# EasyEDA Pro project Athena.epro, schematic Schematic, sheets 3 to 4 of 4

## Sheets
3 Peripherals: Page Name: Peripherals
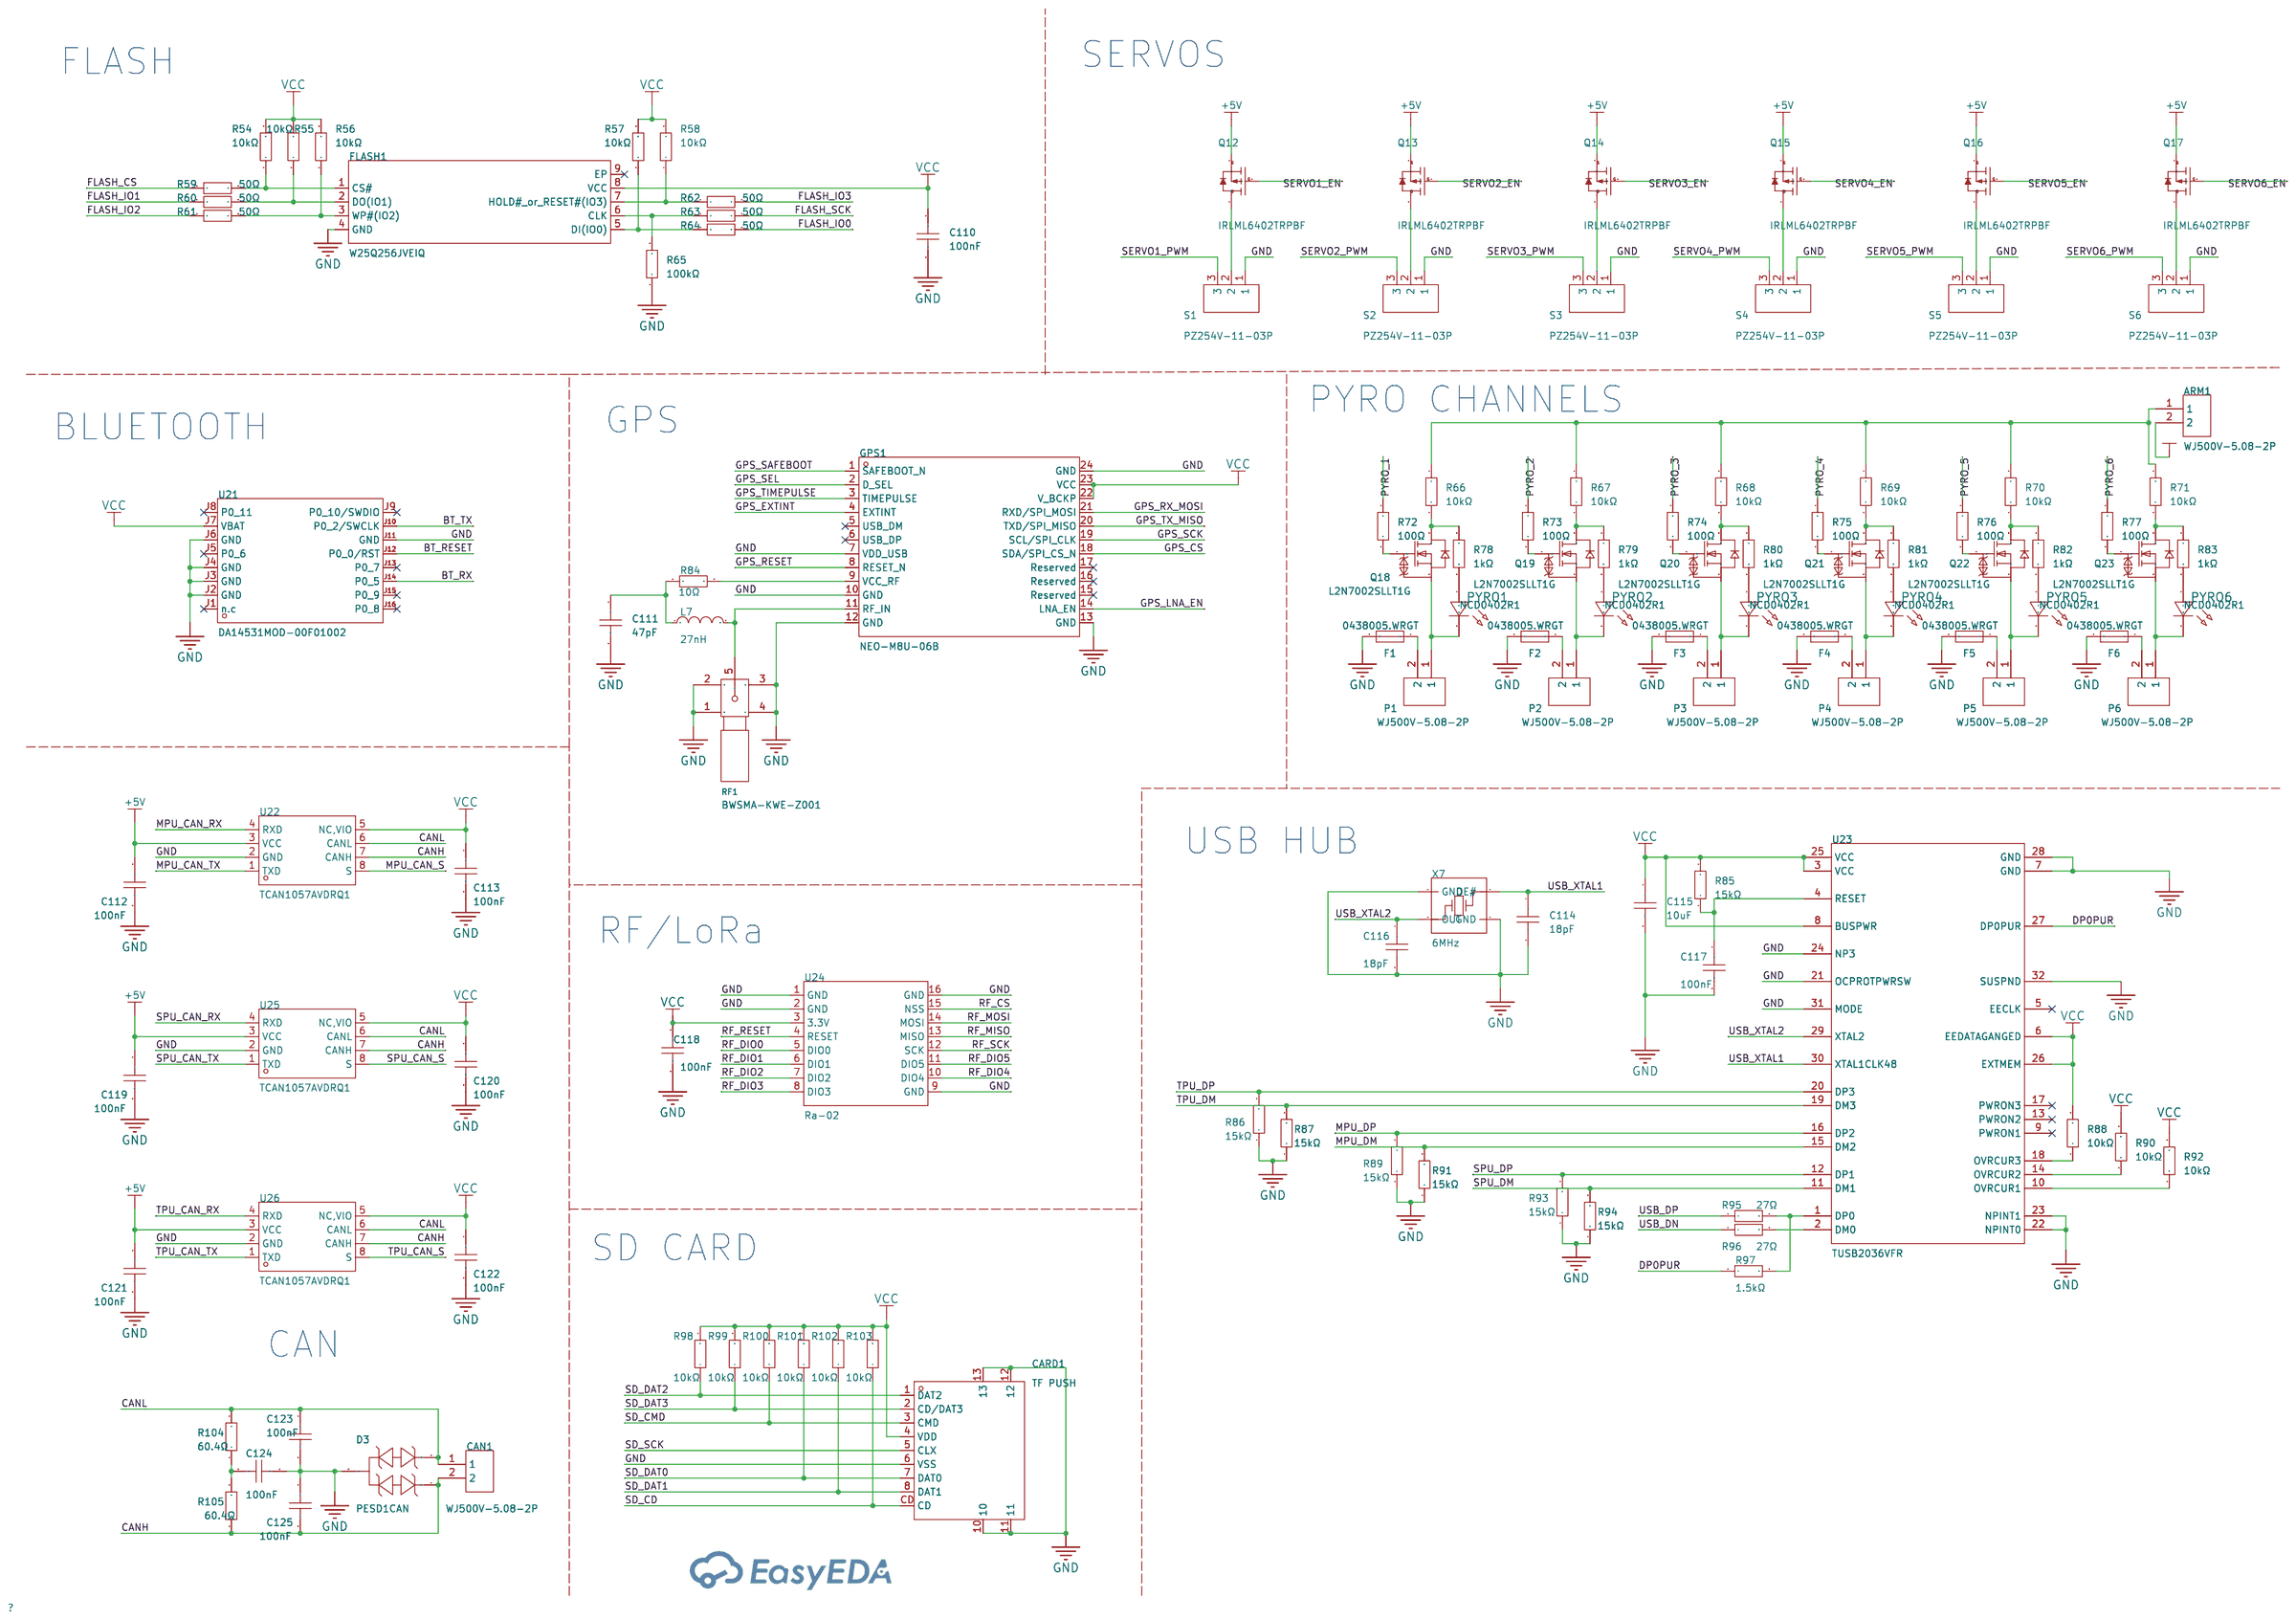
[diagram p2: Peripherals]
4 Sensors: Page Name: Sensors; Update Date: 2025-08-21
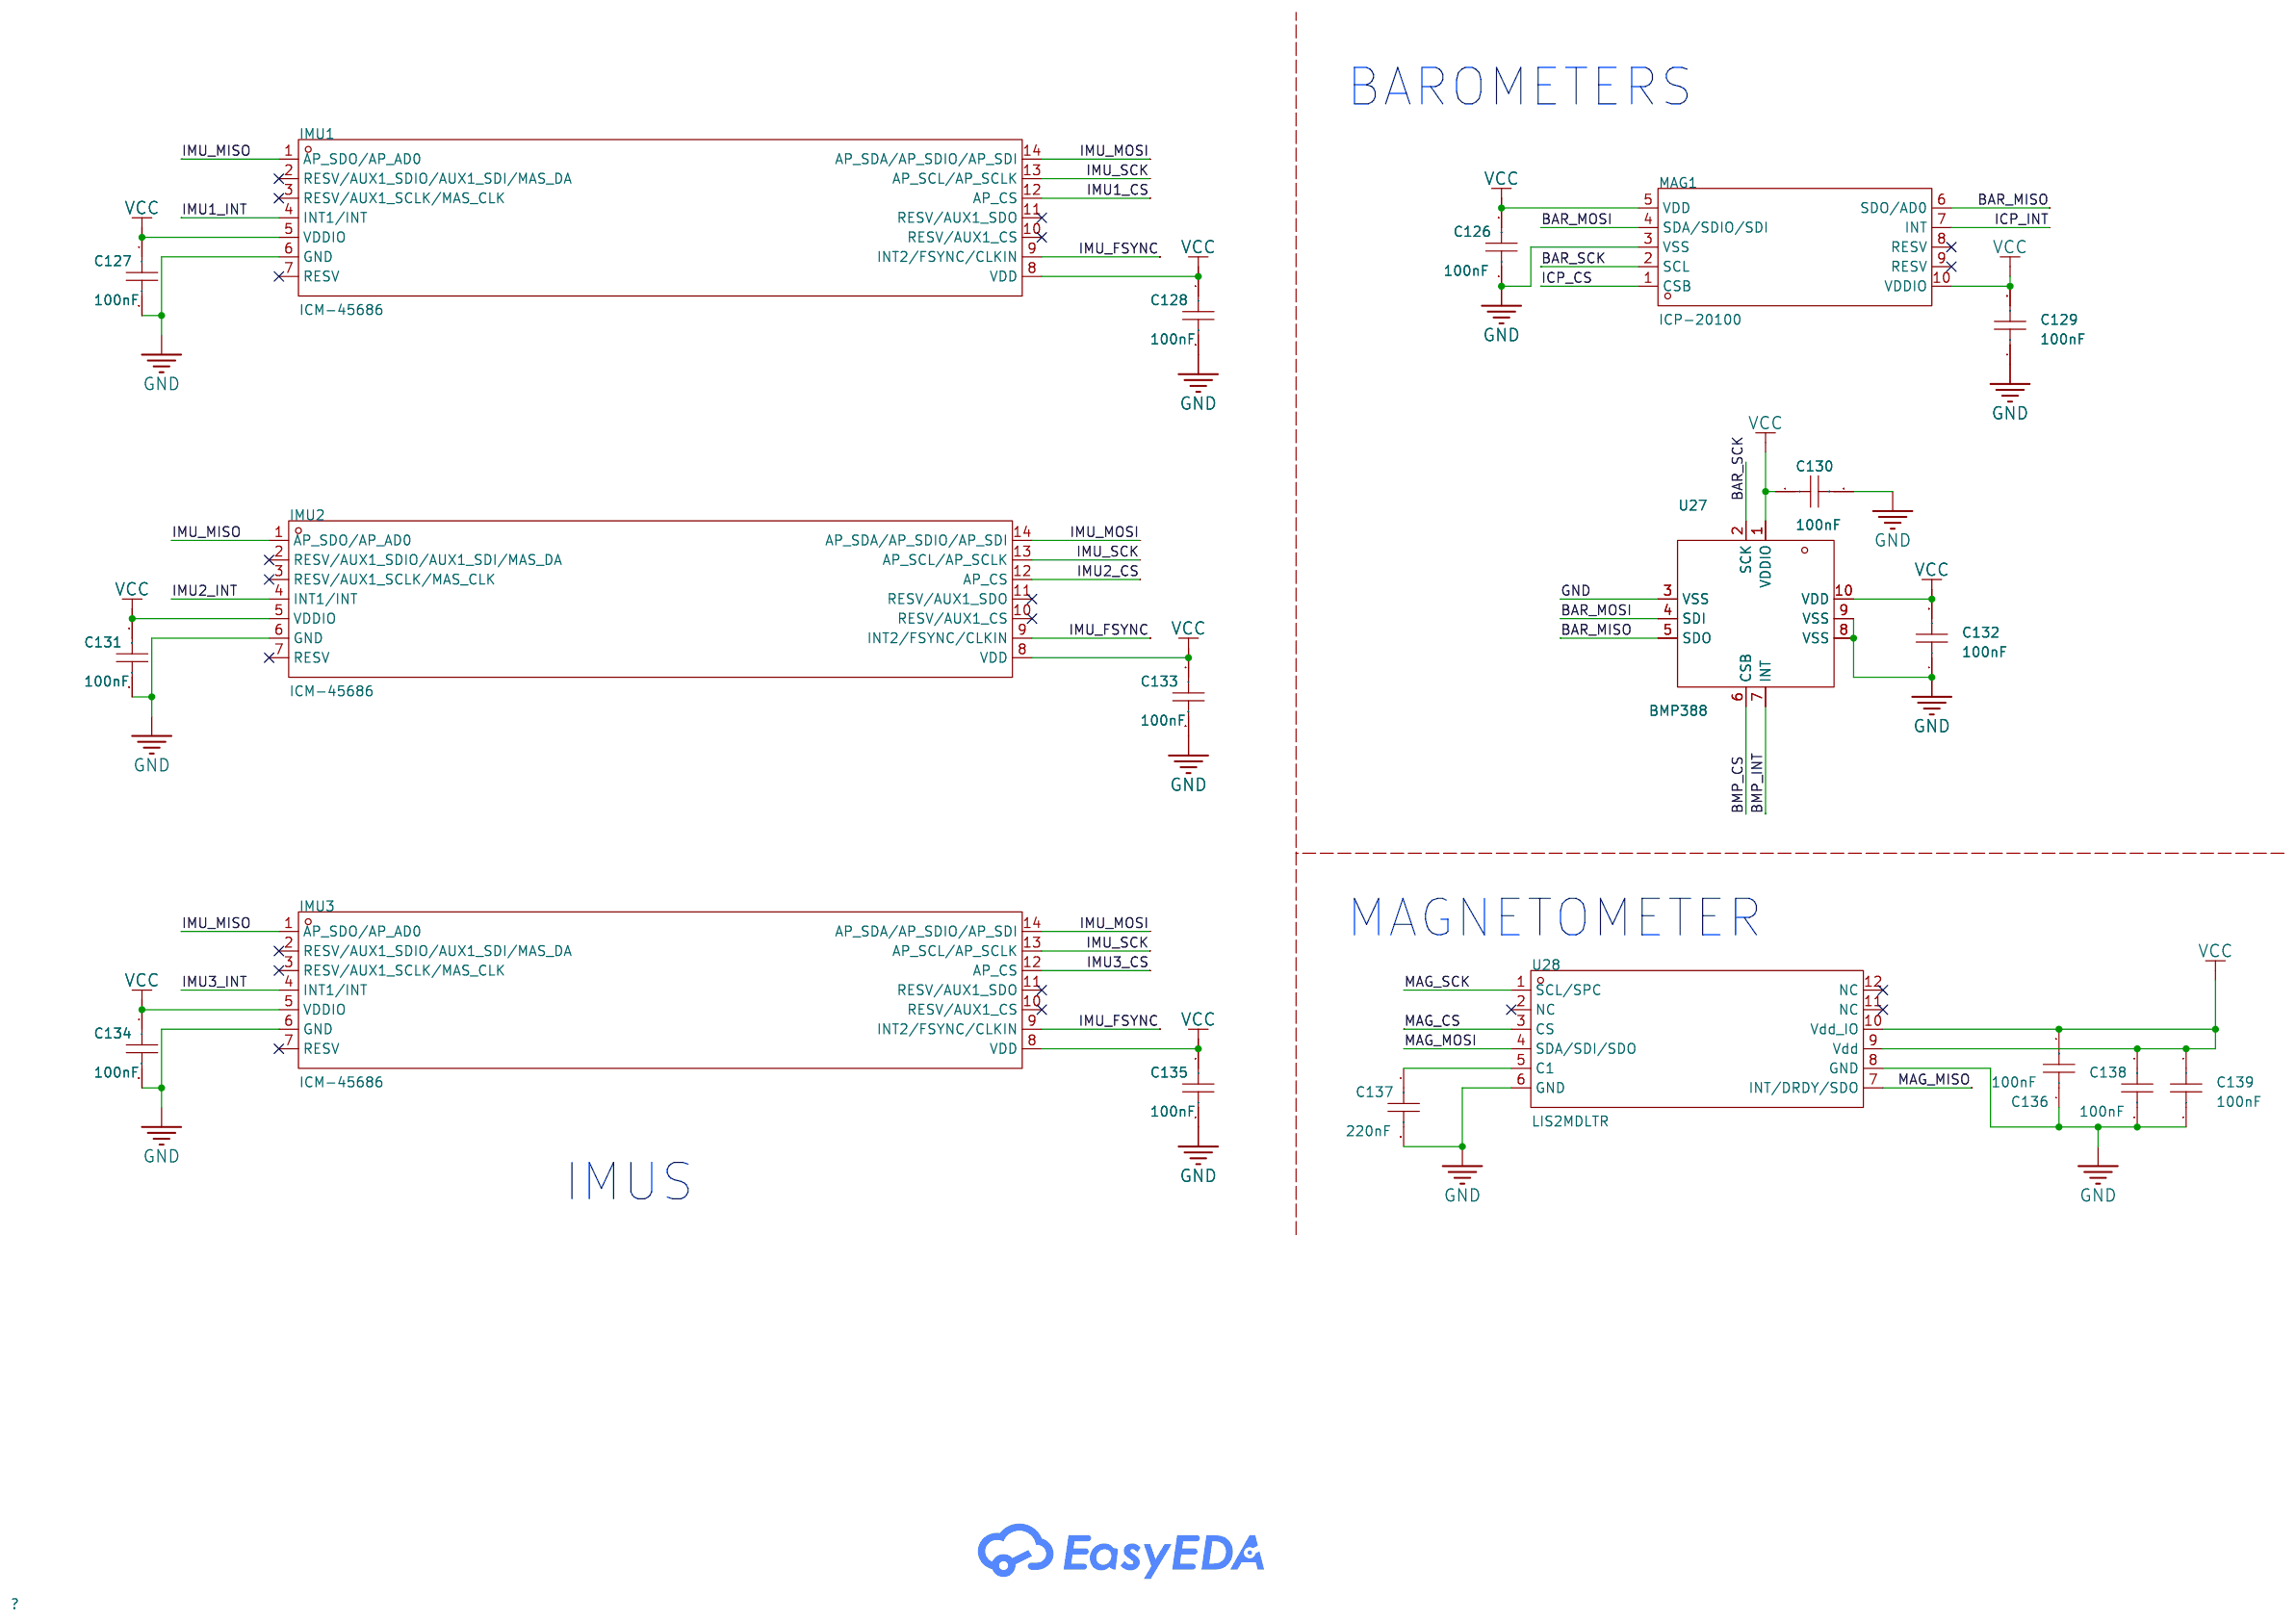
[diagram p3: Sensors]

## Parts
sheet Peripherals
ARM1  WJ500V-5.08-2P  [CONN-TH_2P-P5.00_WJ500V-5.08-2P]
C110  100nF  [C0402]
C111  47pF  [C0402]
C112  100nF  [C0402]
C113  100nF  [C0402]
C114  18pF  [C0402]
C115  10uF  [C0805]
C116  18pF  [C0402]
C117  100nF  [C0402]
C118  100nF  [C0402]
C119  100nF  [C0402]
C120  100nF  [C0402]
C121  100nF  [C0402]
C122  100nF  [C0402]
C123  100nF  [C0402]
C124  100nF  [C0402]
C125  100nF  [C0402]
CAN1  WJ500V-5.08-2P  [CONN-TH_2P-P5.00_WJ500V-5.08-2P]
CARD1  TF PUSH  [TF-SMD_TF-PUSH]
D3  PESD1CAN  [SOT-23-3_L2.9-W1.6-P1.90-LS2.8-BR]
F1  0438005.WRGT  [F0603]
F2  0438005.WRGT  [F0603]
F3  0438005.WRGT  [F0603]
F4  0438005.WRGT  [F0603]
F5  0438005.WRGT  [F0603]
F6  0438005.WRGT  [F0603]
FLASH1  W25Q256JVEIQ  [WSON-8_L8.0-W6.10-P1.27-BL-EP]
GPS1  NEO-M8U-06B  [GPSM-SMD_24P-L16.0-W12.2-P1.10-TL]
L7  27nH  [L0402-RD]
P1  WJ500V-5.08-2P  [CONN-TH_2P-P5.00_WJ500V-5.08-2P]
P2  WJ500V-5.08-2P  [CONN-TH_2P-P5.00_WJ500V-5.08-2P]
P3  WJ500V-5.08-2P  [CONN-TH_2P-P5.00_WJ500V-5.08-2P]
P4  WJ500V-5.08-2P  [CONN-TH_2P-P5.00_WJ500V-5.08-2P]
P5  WJ500V-5.08-2P  [CONN-TH_2P-P5.00_WJ500V-5.08-2P]
P6  WJ500V-5.08-2P  [CONN-TH_2P-P5.00_WJ500V-5.08-2P]
PYRO1  NCD0402R1  [LED0402-RD]
PYRO2  NCD0402R1  [LED0402-RD]
PYRO3  NCD0402R1  [LED0402-RD]
PYRO4  NCD0402R1  [LED0402-RD]
PYRO5  NCD0402R1  [LED0402-RD]
PYRO6  NCD0402R1  [LED0402-RD]
Q12  IRLML6402TRPBF  [SOT-23-3_L2.9-W1.3-P1.90-LS2.4-BR]
Q13  IRLML6402TRPBF  [SOT-23-3_L2.9-W1.3-P1.90-LS2.4-BR]
Q14  IRLML6402TRPBF  [SOT-23-3_L2.9-W1.3-P1.90-LS2.4-BR]
Q15  IRLML6402TRPBF  [SOT-23-3_L2.9-W1.3-P1.90-LS2.4-BR]
Q16  IRLML6402TRPBF  [SOT-23-3_L2.9-W1.3-P1.90-LS2.4-BR]
Q17  IRLML6402TRPBF  [SOT-23-3_L2.9-W1.3-P1.90-LS2.4-BR]
Q18  L2N7002SLLT1G  [SOT-23-3_L3.0-W1.7-P0.95-LS2.9-BR]
Q19  L2N7002SLLT1G  [SOT-23-3_L3.0-W1.7-P0.95-LS2.9-BR]
Q20  L2N7002SLLT1G  [SOT-23-3_L3.0-W1.7-P0.95-LS2.9-BR]
Q21  L2N7002SLLT1G  [SOT-23-3_L3.0-W1.7-P0.95-LS2.9-BR]
Q22  L2N7002SLLT1G  [SOT-23-3_L3.0-W1.7-P0.95-LS2.9-BR]
Q23  L2N7002SLLT1G  [SOT-23-3_L3.0-W1.7-P0.95-LS2.9-BR]
R54  10kΩ  [R0402]
R55  10kΩ  [R0402]
R56  10kΩ  [R0402]
R57  10kΩ  [R0402]
R58  10kΩ  [R0402]
R59  50Ω  [R0402]
R60  50Ω  [R0402]
R61  50Ω  [R0402]
R62  50Ω  [R0402]
R63  50Ω  [R0402]
R64  50Ω  [R0402]
R65  100kΩ  [R0402]
R66  10kΩ  [R0402]
R67  10kΩ  [R0402]
R68  10kΩ  [R0402]
R69  10kΩ  [R0402]
R70  10kΩ  [R0402]
R71  10kΩ  [R0402]
R72  100Ω  [R0402]
R73  100Ω  [R0402]
R74  100Ω  [R0402]
R75  100Ω  [R0402]
R76  100Ω  [R0402]
R77  100Ω  [R0402]
R78  1kΩ  [R0402]
R79  1kΩ  [R0402]
R80  1kΩ  [R0402]
R81  1kΩ  [R0402]
R82  1kΩ  [R0402]
R83  1kΩ  [R0402]
R84  10Ω  [R0402]
R85  15kΩ  [R0402]
R86  15kΩ  [R0402]
R87  15kΩ  [R0402]
R88  10kΩ  [R0402]
R89  15kΩ  [R0402]
R90  10kΩ  [R0402]
R91  15kΩ  [R0402]
R92  10kΩ  [R0402]
R93  15kΩ  [R0402]
R94  15kΩ  [R0402]
R95  27Ω  [R0402]
R96  27Ω  [R0402]
R97  1.5kΩ  [R0402]
R98  10kΩ  [R0402]
R99  10kΩ  [R0402]
R100  10kΩ  [R0402]
R101  10kΩ  [R0402]
R102  10kΩ  [R0402]
R103  10kΩ  [R0402]
R104  60.4Ω  [R0402]
R105  60.4Ω  [R0402]
RF1  BWSMA-KWE-Z001  [SMA-TH_BWSMA-KWE-Z001]
S1  PZ254V-11-03P  [HDR-TH_3P-P2.54-V-M]
S2  PZ254V-11-03P  [HDR-TH_3P-P2.54-V-M]
S3  PZ254V-11-03P  [HDR-TH_3P-P2.54-V-M]
S4  PZ254V-11-03P  [HDR-TH_3P-P2.54-V-M]
S5  PZ254V-11-03P  [HDR-TH_3P-P2.54-V-M]
S6  PZ254V-11-03P  [HDR-TH_3P-P2.54-V-M]
U21  DA14531MOD-00F01002  [WIRELM-SMD-16_L14.5-W12.5-P1.50-DA14531MOD]
U22  TCAN1057AVDRQ1  [SOIC-8_L4.9-W3.9-P1.27-LS6.0-BL]
U23  TUSB2036VFR  [LQFP-32_L7.0-W7.0-P0.80-LS9.0-BL]
U24  Ra-02  [WIRELM-SMD_RA-02-BL]
U25  TCAN1057AVDRQ1  [SOIC-8_L4.9-W3.9-P1.27-LS6.0-BL]
U26  TCAN1057AVDRQ1  [SOIC-8_L4.9-W3.9-P1.27-LS6.0-BL]
X7  6MHz  [OSC-SMD_4P-L7.0-W5.0-BL_ABMM]
sheet Sensors
C126  100nF  [C0402]
C127  100nF  [C0402]
C128  100nF  [C0402]
C129  100nF  [C0402]
C130  100nF  [C0402]
C131  100nF  [C0402]
C132  100nF  [C0402]
C133  100nF  [C0402]
C134  100nF  [C0402]
C135  100nF  [C0402]
C136  100nF  [C0402]
C137  220nF  [C0402]
C138  100nF  [C0402]
C139  100nF  [C0402]
IMU1  ICM-45686  [LGA-14_L3.0-W2.5-P0.50-TL]
IMU2  ICM-45686  [LGA-14_L3.0-W2.5-P0.50-TL]
IMU3  ICM-45686  [LGA-14_L3.0-W2.5-P0.50-TL]
MAG1  ICP-20100  [LGA-10_L2.0-W2.0-P0.50-TL_ICP-20100]
U27  BMP388  [SENSORM-SMD_BMP388]
U28  LIS2MDLTR  [LGA-12_L2.0-W2.0-P0.50-BL]

## Library data of the parts
ARM1 CAN1 P1-P6 = WJ500V-5.08-2P: Structure:1x2P Pitch:5.08mm Color:Green Mounting Style:Direct Insert Current Rating (Max):18A Voltage Rating (Max):250V Number of Pins:2P Number of Rows:1 Wire Gauge - AWG:14~30 Wire Gauge - AWG:14~30 Wire Gauge - mm2:2.5 Wire Gauge - mm2:2.5 Number of PI; LCSC Part Name: 1x2P 5.08mm 直插 排数:1 每排P数:2; Supplier Part: C8465; Manufacturer: KANGNEX(康奈克斯电气); Supplier Footprint: 插件,P=5.08mm; JLCPCB Part Class: Extended Part; Datasheet: https://atta.szlcsc.com/upload/public/pdf/source/20191225/C8465_02D34CE5B5B4A53DF5891601D97FA9F4.pdf; Supplier: LCSC; Structure: 1x2P; Pitch: 5.08mm; Color: Green; Mounting Style: Direct Insert; Current Rating (Max): 18A; Voltage Rating (Max): 250V; Number of Pins: 2P; Number of Rows: 1; Wire Gauge - AWG: 14~30; Wire Gauge - mm2: 2.5; Number of PINs Per Row: 2; Operating Temperature Range: -40℃~+105℃; Screw Specification: M2.5
C110 C112 C113 C117-C136 C138 C139 = GRM155R71H104KE14D: Capacitance: Tolerance:±10% Tolerance:±10% Voltage Rated: Temperature Coefficient:; LCSC Part Name: 100nF ±10% 50V; Supplier Part: C77020; Manufacturer: muRata(村田); Supplier Footprint: 0402; JLCPCB Part Class: Extended Part; Datasheet: https://atta.szlcsc.com/upload/public/pdf/source/20180326/C77020_39BD49C951FF1AF0DB1F1FAC5AC1E401.pdf; Supplier: LCSC; Tolerance: ±10%; Standardization Check: false
C111 = GRM1555C1H470JA01D: Capacitance: Tolerance:±5% Tolerance:±5% Voltage Rated: Temperature Coefficient:; LCSC Part Name: 47pF ±5% 50V; Supplier Part: C76970; Manufacturer: muRata(村田); Supplier Footprint: 0402; JLCPCB Part Class: Extended Part; Datasheet: https://atta.szlcsc.com/upload/public/pdf/source/20180326/C76970_6FDF160D4C40A32DF03646FA34DB0595.pdf; Supplier: LCSC; Tolerance: ±5%; Standardization Check: false
C114 C116 = CC0402JRNPO9BN180: Capacitance:18pF Tolerance:±5% Tolerance:±5% Voltage Rating:50V Temperature Coefficient:NP0; LCSC Part Name: 18pF ±5% 50V; Supplier Part: C106202; Manufacturer: YAGEO(国巨); Supplier Footprint: 0402; JLCPCB Part Class: Extended Part; Datasheet: https://item.szlcsc.com/datasheet/CC0402JRNPO9BN180/107417.html; Supplier: LCSC; Tolerance: ±5%; Voltage Rating: 50V; Temperature Coefficient: NP0; Standardization Check: false
C115 = GRM21BR61H106KE43L: Capacitance: Tolerance:±10% Tolerance:±10% Voltage Rated: Temperature Coefficient:; LCSC Part Name: 10uF ±10% 50V; Supplier Part: C440198; Manufacturer: muRata(村田); Supplier Footprint: 0805; JLCPCB Part Class: Basic Part; Datasheet: https://atta.szlcsc.com/upload/public/pdf/source/20230811/95AAE0C9AF55EDC31B7A4D8B733F534E.pdf; Supplier: LCSC; Tolerance: ±10%; Standardization Check: false
CARD1 = TF PUSH: Card Connection Mode:Self-bouncing Card Type:MicroSD card (TF card) Connector Type:Card Slot Additional Card Detection Pins:None Supplementary Features:- Maximum Body Height:2mm Operating Temperature Range:-20℃~+90℃ Operating Temperature Range:-20℃~+90℃; LCSC Part Name: 自弹式 MicroSD卡(TF卡) 卡座; Supplier Part: C393941; Manufacturer: SHOU HAN(首韩); Supplier Footprint: SMD; JLCPCB Part Class: Extended Part; Datasheet: https://atta.szlcsc.com/upload/public/pdf/source/20191011/C393941_0DDD896EE907FEB750D8B7B8982E2A67.pdf; Supplier: LCSC; Card Connection Mode: Self-bouncing; Card Type: MicroSD card (TF card); Connector Type: Card Slot; Additional Card Detection Pins: None; Maximum Body Height: 2mm; Operating Temperature Range: -20℃~+90℃
D3 = PESD1CAN_C907838: Polarity:Bidirectional Reverse Stand-Off Voltage (Vrwm):24V Clamping Voltage:50V Peak Pulse Current (Ipp):3A Peak Pulse Power Dissipation (Ppp):150W Voltage - Breakdown:25V Reverse Leakage Current (Ir):80nA Number of Channels:Dual channel Operating Temper; LCSC Part Name: PESD1CAN 丝印tAN 双向24V; Supplier Part: C907838; Manufacturer: TECH PUBLIC(台舟); Supplier Footprint: SOT-23; JLCPCB Part Class: Extended Part; Datasheet: https://atta.szlcsc.com/upload/public/pdf/source/20210810/FCC54A7A88EA9EF2EA40F9636152B7D7.pdf; Supplier: LCSC; Polarity: Bidirectional; Reverse Stand-Off Voltage (Vrwm): 24V; Clamping Voltage: 50V; Peak Pulse Current (Ipp): 3A; Peak Pulse Power Dissipation (Ppp): 150W; Voltage - Breakdown: 25V; Reverse Leakage Current (Ir): 80nA; Number of Channels: Dual channel; Operating Temperature: -55℃~+125℃; level of protection: IEC 61000-4-2; Type: ESD
F1-F6 = 0438005.WRGT: Type:Surface Mount Fuse Current Rating:5A Voltage Rating (AC):12V Voltage Rating (DC):32V Operating Temperature:-55℃~+150℃ Operating Temperature:-55℃~+150℃ Interrupt Rating:50A；50A; LCSC Part Name: 12V贴片式陶瓷保险丝; Supplier Part: C206961; Manufacturer: Littelfuse(美国力特); Supplier Footprint: 0603; JLCPCB Part Class: Extended Part; Datasheet: https://atta.szlcsc.com/upload/public/pdf/source/20180622/C221526_4FA6BB8CAFBB117CF66A16621571BD77.pdf; Supplier: LCSC; Type: Surface Mount Fuse; Current Rating: 5A; Voltage Rating (AC): 12V; Voltage Rating (DC): 32V; Operating Temperature: -55℃~+150℃; Interrupt Rating: 50A；50A
FLASH1 = W25Q256JVEIQ_C97522: Interface:SPI Memory Size:256Mbit Clock Frequency:133MHz Voltage - Supply:2.7V~3.6V Voltage - Supply:2.7V~3.6V Program / Erase Cycles:100,000 Cycles Page Programming Time (Tpp):700us Block Erase Time(tBE):120ms@(32KB) Data Retention - TDR (Year):20 Years; Supplier Part: C97522; Manufacturer: Winbond(华邦); Supplier Footprint: WSON-8-EP(6x8); JLCPCB Part Class: Extended Part; Datasheet: https://atta.szlcsc.com/upload/public/pdf/source/20190529/C97522_47AE152D0BB11FB4C8509E398C0AD2EA.pdf; Supplier: LCSC; Interface: SPI; Memory Size: 256Mbit; Clock Frequency: 133MHz; Voltage - Supply: 2.7V~3.6V; Program / Erase Cycles: 100,000 Cycles; Page Programming Time (Tpp): 700us; Block Erase Time(tBE): 120ms@(32KB); Data Retention - TDR (Year): 20 Years; Operating Temperature: -40℃~+85℃
GPS1 = NEO-M8U-06B: GNSS Type:Galileo；GLONASS；GPS；BeiDou Interface:UART；I2C；USB；SPI Voltage - Supply:2.7V~3.6V Voltage - Supply:2.7V~3.6V Sensitivity:-160dBm Sensitivity:-160dBm Operating Temperature:-40℃~+85℃ Operating Temperature:-40℃~+85℃; Supplier Part: C7009321; Manufacturer: U-BLOX; Supplier Footprint: SMD-24P; JLCPCB Part Class: Extended Part; Datasheet: https://atta.szlcsc.com/upload/public/pdf/source/20240423/523A52209E2FEFC8D2EB30DE7E259982.pdf; Supplier: LCSC; GNSS Type: Galileo；GLONASS；GPS；BeiDou; Interface: UART；I2C；USB；SPI; Voltage - Supply: 2.7V~3.6V; Sensitivity: -160dBm; Operating Temperature: -40℃~+85℃